# Altium schematic sheet CoinCraftA1.SchDoc (part 1 of 2) (continued)
## Parts (continued)
C6-3SO  value 470nF  [SMD_0603_CAPC1608X80N]  (hidden comment: (OPT) 470nF)
C6-4MO  (OPT)22uF/6.3V  [SMD_0805_CAPC2012X145N]
C6-4S  470nF  [SMD_0603_CAPC1608X80N]
C6-4SO  value 470nF  [SMD_0603_CAPC1608X80N]  (hidden comment: (OPT) 470nF)
C6-5  10uF/16V  [SMD_0805_CAPC2012X145N]
C6-5MO  (OPT)22uF/6.3V  [SMD_0805_CAPC2012X145N]
C6-5S  470nF  [SMD_0603_CAPC1608X80N]
C6-5SO  value 470nF  [SMD_0603_CAPC1608X80N]  (hidden comment: (OPT) 470nF)
C6-6  10uF/16V  [SMD_0805_CAPC2012X145N]
C6-6MO  (OPT)22uF/6.3V  [SMD_0805_CAPC2012X145N]
C6-6S  470nF  [SMD_0603_CAPC1608X80N]
C6-6SO  value 470nF  [SMD_0603_CAPC1608X80N]  (hidden comment: (OPT) 470nF)
C6-7MO  (OPT)22uF/6.3V  [SMD_0805_CAPC2012X145N]
C6-7S  470nF  [SMD_0603_CAPC1608X80N]
C6-7SO  value 470nF  [SMD_0603_CAPC1608X80N]  (hidden comment: (OPT) 470nF)
C6-8MO  (OPT)22uF/6.3V  [SMD_0805_CAPC2012X145N]
C6-8S  470nF  [SMD_0603_CAPC1608X80N]
C6-8SO  value 470nF  [SMD_0603_CAPC1608X80N]  (hidden comment: (OPT) 470nF)
C6_0  (OPT)22uF/6.3V  [SMD_0805_CAPC2012X145N]
C7-1MO  (OPT)22uF/6.3V  [SMD_0805_CAPC2012X145N]
C7-1S  470nF  [SMD_0603_CAPC1608X80N]
C7-1SO  value 470nF  [SMD_0603_CAPC1608X80N]  (hidden comment: (OPT) 470nF)
C7-2MO  (OPT)22uF/6.3V  [SMD_0805_CAPC2012X145N]
C7-2S  470nF  [SMD_0603_CAPC1608X80N]
C7-2SO  value 470nF  [SMD_0603_CAPC1608X80N]  (hidden comment: (OPT) 470nF)
C7-3MO  (OPT)22uF/6.3V  [SMD_0805_CAPC2012X145N]
C7-3S  470nF  [SMD_0603_CAPC1608X80N]
C7-3SO  value 470nF  [SMD_0603_CAPC1608X80N]  (hidden comment: (OPT) 470nF)
C7-4MO  (OPT)22uF/6.3V  [SMD_0805_CAPC2012X145N]
C7-4S  470nF  [SMD_0603_CAPC1608X80N]
C7-4SO  value 470nF  [SMD_0603_CAPC1608X80N]  (hidden comment: (OPT) 470nF)
C7-5  10uF/16V  [SMD_0805_CAPC2012X145N]
C7-5MO  (OPT)22uF/6.3V  [SMD_0805_CAPC2012X145N]
C7-5S  470nF  [SMD_0603_CAPC1608X80N]
C7-5SO  value 470nF  [SMD_0603_CAPC1608X80N]  (hidden comment: (OPT) 470nF)
C7-6  10uF/16V  [SMD_0805_CAPC2012X145N]
C7-6MO  (OPT)22uF/6.3V  [SMD_0805_CAPC2012X145N]
C7-6S  470nF  [SMD_0603_CAPC1608X80N]
C7-6SO  value 470nF  [SMD_0603_CAPC1608X80N]  (hidden comment: (OPT) 470nF)
C7-7MO  (OPT)22uF/6.3V  [SMD_0805_CAPC2012X145N]
C7-7S  470nF  [SMD_0603_CAPC1608X80N]
C7-7SO  value 470nF  [SMD_0603_CAPC1608X80N]  (hidden comment: (OPT) 470nF)
C7-8MO  (OPT)22uF/6.3V  [SMD_0805_CAPC2012X145N]
C7-8S  470nF  [SMD_0603_CAPC1608X80N]
C7-8SO  value 470nF  [SMD_0603_CAPC1608X80N]  (hidden comment: (OPT) 470nF)
C7_0  (OPT)22uF/6.3V  [SMD_0805_CAPC2012X145N]
C8-1MO  (OPT)22uF/6.3V  [SMD_0805_CAPC2012X145N]
C8-1S  470nF  [SMD_0603_CAPC1608X80N]
C8-1SO  value 470nF  [SMD_0603_CAPC1608X80N]  (hidden comment: (OPT) 470nF)
C8-2MO  (OPT)22uF/6.3V  [SMD_0805_CAPC2012X145N]
C8-2S  470nF  [SMD_0603_CAPC1608X80N]
C8-2SO  value 470nF  [SMD_0603_CAPC1608X80N]  (hidden comment: (OPT) 470nF)
C8-3MO  (OPT)22uF/6.3V  [SMD_0805_CAPC2012X145N]
C8-3S  470nF  [SMD_0603_CAPC1608X80N]
C8-3SO  value 470nF  [SMD_0603_CAPC1608X80N]  (hidden comment: (OPT) 470nF)
C8-4MO  (OPT)22uF/6.3V  [SMD_0805_CAPC2012X145N]
C8-4S  470nF  [SMD_0603_CAPC1608X80N]
C8-4SO  value 470nF  [SMD_0603_CAPC1608X80N]  (hidden comment: (OPT) 470nF)
C8-5  10uF/16V  [SMD_0805_CAPC2012X145N]
C8-5MO  (OPT)22uF/6.3V  [SMD_0805_CAPC2012X145N]
C8-5S  470nF  [SMD_0603_CAPC1608X80N]
C8-5SO  value 470nF  [SMD_0603_CAPC1608X80N]  (hidden comment: (OPT) 470nF)
C8-6  10uF/16V  [SMD_0805_CAPC2012X145N]
C8-6MO  (OPT)22uF/6.3V  [SMD_0805_CAPC2012X145N]
C8-6S  470nF  [SMD_0603_CAPC1608X80N]
C8-6SO  value 470nF  [SMD_0603_CAPC1608X80N]  (hidden comment: (OPT) 470nF)
C8-7MO  (OPT)22uF/6.3V  [SMD_0805_CAPC2012X145N]
C8-7S  470nF  [SMD_0603_CAPC1608X80N]
C8-7SO  value 470nF  [SMD_0603_CAPC1608X80N]  (hidden comment: (OPT) 470nF)
C8-8MO  (OPT)22uF/6.3V  [SMD_0805_CAPC2012X145N]
C8-8S  470nF  [SMD_0603_CAPC1608X80N]
C8-8SO  value 470nF  [SMD_0603_CAPC1608X80N]  (hidden comment: (OPT) 470nF)
C8_0  (OPT)22uF/6.3V  [SMD_0805_CAPC2012X145N]
C9-1MO  (OPT)22uF/6.3V  [SMD_0805_CAPC2012X145N]
C9-1S  470nF  [SMD_0603_CAPC1608X80N]
C9-1SO  value 470nF  [SMD_0603_CAPC1608X80N]  (hidden comment: (OPT) 470nF)
C9-2MO  (OPT)22uF/6.3V  [SMD_0805_CAPC2012X145N]
C9-2S  470nF  [SMD_0603_CAPC1608X80N]
C9-2SO  value 470nF  [SMD_0603_CAPC1608X80N]  (hidden comment: (OPT) 470nF)
C9-3MO  (OPT)22uF/6.3V  [SMD_0805_CAPC2012X145N]
C9-3S  470nF  [SMD_0603_CAPC1608X80N]
C9-3SO  value 470nF  [SMD_0603_CAPC1608X80N]  (hidden comment: (OPT) 470nF)
C9-4MO  (OPT)22uF/6.3V  [SMD_0805_CAPC2012X145N]
C9-4S  470nF  [SMD_0603_CAPC1608X80N]
C9-4SO  value 470nF  [SMD_0603_CAPC1608X80N]  (hidden comment: (OPT) 470nF)
C9-5  10uF/16V  [SMD_0805_CAPC2012X145N]
C9-5MO  (OPT)22uF/6.3V  [SMD_0805_CAPC2012X145N]
C9-5S  470nF  [SMD_0603_CAPC1608X80N]
C9-5SO  value 470nF  [SMD_0603_CAPC1608X80N]  (hidden comment: (OPT) 470nF)
C9-6  10uF/16V  [SMD_0805_CAPC2012X145N]
C9-6MO  (OPT)22uF/6.3V  [SMD_0805_CAPC2012X145N]
C9-6S  470nF  [SMD_0603_CAPC1608X80N]
C9-6SO  value 470nF  [SMD_0603_CAPC1608X80N]  (hidden comment: (OPT) 470nF)
C9-7MO  (OPT)22uF/6.3V  [SMD_0805_CAPC2012X145N]
C9-7S  470nF  [SMD_0603_CAPC1608X80N]
C9-7SO  value 470nF  [SMD_0603_CAPC1608X80N]  (hidden comment: (OPT) 470nF)
C9-8MO  (OPT)22uF/6.3V  [SMD_0805_CAPC2012X145N]
C9-8S  470nF  [SMD_0603_CAPC1608X80N]
C9-8SO  value 470nF  [SMD_0603_CAPC1608X80N]  (hidden comment: (OPT) 470nF)
C9_0  (OPT)22uF/6.3V  [SMD_0805_CAPC2012X145N]
C10-1MO  (OPT)22uF/6.3V  [SMD_0805_CAPC2012X145N]
C10-1S  470nF  [SMD_0603_CAPC1608X80N]
C10-1SO  value 470nF  [SMD_0603_CAPC1608X80N]  (hidden comment: (OPT) 470nF)
C10-2MO  (OPT)22uF/6.3V  [SMD_0805_CAPC2012X145N]
C10-2S  470nF  [SMD_0603_CAPC1608X80N]
C10-2SO  value 470nF  [SMD_0603_CAPC1608X80N]  (hidden comment: (OPT) 470nF)
C10-3MO  (OPT)22uF/6.3V  [SMD_0805_CAPC2012X145N]
C10-3S  470nF  [SMD_0603_CAPC1608X80N]
C10-3SO  value 470nF  [SMD_0603_CAPC1608X80N]  (hidden comment: (OPT) 470nF)
C10-4MO  (OPT)22uF/6.3V  [SMD_0805_CAPC2012X145N]
C10-4S  470nF  [SMD_0603_CAPC1608X80N]
C10-4SO  value 470nF  [SMD_0603_CAPC1608X80N]  (hidden comment: (OPT) 470nF)
C10-5  10uF/16V  [SMD_0805_CAPC2012X145N]
C10-5MO  (OPT)22uF/6.3V  [SMD_0805_CAPC2012X145N]
C10-5S  470nF  [SMD_0603_CAPC1608X80N]
C10-5SO  value 470nF  [SMD_0603_CAPC1608X80N]  (hidden comment: (OPT) 470nF)
C10-6  10uF/16V  [SMD_0805_CAPC2012X145N]
C10-6MO  (OPT)22uF/6.3V  [SMD_0805_CAPC2012X145N]
C10-6S  470nF  [SMD_0603_CAPC1608X80N]
C10-6SO  value 470nF  [SMD_0603_CAPC1608X80N]  (hidden comment: (OPT) 470nF)
C10-7MO  (OPT)22uF/6.3V  [SMD_0805_CAPC2012X145N]
C10-7S  470nF  [SMD_0603_CAPC1608X80N]
C10-7SO  value 470nF  [SMD_0603_CAPC1608X80N]  (hidden comment: (OPT) 470nF)
C10-8MO  (OPT)22uF/6.3V  [SMD_0805_CAPC2012X145N]
C10-8S  470nF  [SMD_0603_CAPC1608X80N]
C10-8SO  value 470nF  [SMD_0603_CAPC1608X80N]  (hidden comment: (OPT) 470nF)
C10_0  (OPT)22uF/6.3V  [SMD_0805_CAPC2012X145N]
C11-1MO  (OPT)22uF/6.3V  [SMD_0805_CAPC2012X145N]
C11-1SO  value 470nF  [SMD_0603_CAPC1608X80N]  (hidden comment: (OPT) 470nF)
C11-2MO  (OPT)22uF/6.3V  [SMD_0805_CAPC2012X145N]
C11-2S  470nF  [SMD_0603_CAPC1608X80N]
C11-2SO  value 470nF  [SMD_0603_CAPC1608X80N]  (hidden comment: (OPT) 470nF)
C11-3MO  (OPT)22uF/6.3V  [SMD_0805_CAPC2012X145N]
C11-3S  470nF  [SMD_0603_CAPC1608X80N]
C11-3SO  value 470nF  [SMD_0603_CAPC1608X80N]  (hidden comment: (OPT) 470nF)
C11-5  10uF/16V  [SMD_0805_CAPC2012X145N]
C11-5MO  (OPT)22uF/6.3V  [SMD_0805_CAPC2012X145N]
C11-5SO  value 470nF  [SMD_0603_CAPC1608X80N]  (hidden comment: (OPT) 470nF)
C11-6  10uF/16V  [SMD_0805_CAPC2012X145N]
C11-6S  470nF  [SMD_0603_CAPC1608X80N]
C11-7S  470nF  [SMD_0603_CAPC1608X80N]
C11-8MO  (OPT)22uF/6.3V  [SMD_0805_CAPC2012X145N]
C11-8SO  value 470nF  [SMD_0603_CAPC1608X80N]  (hidden comment: (OPT) 470nF)
C11_0  (OPT)22uF/6.3V  [SMD_0805_CAPC2012X145N]
C11_1  22uF/6.3V  [SMD_0805_CAPC2012X145N]
C11_2  22uF/6.3V  [SMD_0805_CAPC2012X145N]
C11_3  22uF/6.3V  [SMD_0805_CAPC2012X145N]
C11_4  22uF/6.3V  [SMD_0805_CAPC2012X145N]
C12-1MO  (OPT)22uF/6.3V  [SMD_0805_CAPC2012X145N]
C12-1SO  value 470nF  [SMD_0603_CAPC1608X80N]  (hidden comment: (OPT) 470nF)
C12-2MO  (OPT)22uF/6.3V  [SMD_0805_CAPC2012X145N]
C12-2S  470nF  [SMD_0603_CAPC1608X80N]
C12-2SO  value 470nF  [SMD_0603_CAPC1608X80N]  (hidden comment: (OPT) 470nF)
C12-3MO  (OPT)22uF/6.3V  [SMD_0805_CAPC2012X145N]
C12-3S  470nF  [SMD_0603_CAPC1608X80N]
C12-3SO  value 470nF  [SMD_0603_CAPC1608X80N]  (hidden comment: (OPT) 470nF)
C12-5  10uF/16V  [SMD_0805_CAPC2012X145N]
C12-5MO  (OPT)22uF/6.3V  [SMD_0805_CAPC2012X145N]
C12-5SO  value 470nF  [SMD_0603_CAPC1608X80N]  (hidden comment: (OPT) 470nF)
C12-6  10uF/16V  [SMD_0805_CAPC2012X145N]
C12-6S  470nF  [SMD_0603_CAPC1608X80N]
C12-7S  470nF  [SMD_0603_CAPC1608X80N]
C12-8MO  (OPT)22uF/6.3V  [SMD_0805_CAPC2012X145N]
C12-8SO  value 470nF  [SMD_0603_CAPC1608X80N]  (hidden comment: (OPT) 470nF)
C12_0  (OPT)22uF/6.3V  [SMD_0805_CAPC2012X145N]
C12_1  22uF/6.3V  [SMD_0805_CAPC2012X145N]
C12_2  22uF/6.3V  [SMD_0805_CAPC2012X145N]
C12_3  22uF/6.3V  [SMD_0805_CAPC2012X145N]
C12_4  22uF/6.3V  [SMD_0805_CAPC2012X145N]
C13-2S  470nF  [SMD_0603_CAPC1608X80N]
C13-3S  470nF  [SMD_0603_CAPC1608X80N]
C13-5  10uF/16V  [SMD_0805_CAPC2012X145N]
C13-5MO  (OPT)22uF/6.3V  [SMD_0805_CAPC2012X145N]
C13-5SO  value 470nF  [SMD_0603_CAPC1608X80N]  (hidden comment: (OPT) 470nF)
C13-6  10uF/16V  [SMD_0805_CAPC2012X145N]
C13-6S  470nF  [SMD_0603_CAPC1608X80N]
C13-7S  470nF  [SMD_0603_CAPC1608X80N]
C13-8MO  (OPT)22uF/6.3V  [SMD_0805_CAPC2012X145N]
C13-8SO  value 470nF  [SMD_0603_CAPC1608X80N]  (hidden comment: (OPT) 470nF)
C13_0  (OPT)22uF/6.3V  [SMD_0805_CAPC2012X145N]
C13_1  22uF/6.3V  [SMD_0805_CAPC2012X145N]
C13_2  22uF/6.3V  [SMD_0805_CAPC2012X145N]
C13_3  22uF/6.3V  [SMD_0805_CAPC2012X145N]
C13_4  22uF/6.3V  [SMD_0805_CAPC2012X145N]
C14-5  10uF/16V  [SMD_0805_CAPC2012X145N]
C14-5MO  (OPT)22uF/6.3V  [SMD_0805_CAPC2012X145N]
C14-5SO  value 470nF  [SMD_0603_CAPC1608X80N]  (hidden comment: (OPT) 470nF)
C14-6  10uF/16V  [SMD_0805_CAPC2012X145N]
C14-8MO  (OPT)22uF/6.3V  [SMD_0805_CAPC2012X145N]
C14-8SO  value 470nF  [SMD_0603_CAPC1608X80N]  (hidden comment: (OPT) 470nF)
C14_0  (OPT)22uF/6.3V  [SMD_0805_CAPC2012X145N]
C14_1  22uF/6.3V  [SMD_0805_CAPC2012X145N]
C14_2  22uF/6.3V  [SMD_0805_CAPC2012X145N]
C14_3  22uF/6.3V  [SMD_0805_CAPC2012X145N]
C14_4  22uF/6.3V  [SMD_0805_CAPC2012X145N]
C15-5  10uF/16V  [SMD_0805_CAPC2012X145N]
C15-6  10uF/16V  [SMD_0805_CAPC2012X145N]
C15-8MO  (OPT)22uF/6.3V  [SMD_0805_CAPC2012X145N]
C15-8SO  value 470nF  [SMD_0603_CAPC1608X80N]  (hidden comment: (OPT) 470nF)
C15_0  (OPT)22uF/6.3V  [SMD_0805_CAPC2012X145N]
C15_1  22uF/6.3V  [SMD_0805_CAPC2012X145N]
C15_2  22uF/6.3V  [SMD_0805_CAPC2012X145N]
C15_3  22uF/6.3V  [SMD_0805_CAPC2012X145N]
C15_4  22uF/6.3V  [SMD_0805_CAPC2012X145N]
C16-5  10uF/16V  [SMD_0805_CAPC2012X145N]
C16-6  10uF/16V  [SMD_0805_CAPC2012X145N]
C16-8MO  (OPT)22uF/6.3V  [SMD_0805_CAPC2012X145N]
C16-8SO  value 470nF  [SMD_0603_CAPC1608X80N]  (hidden comment: (OPT) 470nF)
C16_0  (OPT)22uF/6.3V  [SMD_0805_CAPC2012X145N]
C16_1  22uF/6.3V  [SMD_0805_CAPC2012X145N]
C16_2  22uF/6.3V  [SMD_0805_CAPC2012X145N]
C16_3  22uF/6.3V  [SMD_0805_CAPC2012X145N]
C16_4  22uF/6.3V  [SMD_0805_CAPC2012X145N]
C17  10uF/16V  [SMD_0805_CAPC2012X145N]
C17_0  (OPT)22uF/6.3V  [SMD_0805_CAPC2012X145N]
C17_1  22uF/6.3V  [SMD_0805_CAPC2012X145N]
C17_2  22uF/6.3V  [SMD_0805_CAPC2012X145N]
C17_3  22uF/6.3V  [SMD_0805_CAPC2012X145N]
C17_4  22uF/6.3V  [SMD_0805_CAPC2012X145N]
C18_0  (OPT)22uF/6.3V  [SMD_0805_CAPC2012X145N]
C18_1  22uF/6.3V  [SMD_0805_CAPC2012X145N]
C18_2  22uF/6.3V  [SMD_0805_CAPC2012X145N]
C18_3  22uF/6.3V  [SMD_0805_CAPC2012X145N]
C18_4  22uF/6.3V  [SMD_0805_CAPC2012X145N]
C19_1  22uF/6.3V  [SMD_0805_CAPC2012X145N]
C19_2  22uF/6.3V  [SMD_0805_CAPC2012X145N]
C19_3  22uF/6.3V  [SMD_0805_CAPC2012X145N]
C19_4  22uF/6.3V  [SMD_0805_CAPC2012X145N]
C20-5  (OPT)100uF  [SMD_1210_CAPC3225X279N]
C20-6  (OPT)100uF  [SMD_1210_CAPC3225X279N]
C20_0  220uF  [SMD_1210_CAPC3225X279N]
C20_1  22uF/6.3V  [SMD_0805_CAPC2012X145N]
C20_2  22uF/6.3V  [SMD_0805_CAPC2012X145N]
C20_3  22uF/6.3V  [SMD_0805_CAPC2012X145N]
C20_4  22uF/6.3V  [SMD_0805_CAPC2012X145N]
C21-5  (OPT)100uF  [SMD_1210_CAPC3225X279N]
C21-6  (OPT)100uF  [SMD_1210_CAPC3225X279N]
C21_0  220uF  [SMD_1210_CAPC3225X279N]
C21_1  22uF/6.3V  [SMD_0805_CAPC2012X145N]
C21_2  22uF/6.3V  [SMD_0805_CAPC2012X145N]
C21_3  22uF/6.3V  [SMD_0805_CAPC2012X145N]
C21_4  22uF/6.3V  [SMD_0805_CAPC2012X145N]
C22-5  (OPT)100uF  [SMD_1210_CAPC3225X279N]
C22-6  (OPT)100uF  [SMD_1210_CAPC3225X279N]
C22_0  220uF  [SMD_1210_CAPC3225X279N]
C22_1  22uF/6.3V  [SMD_0805_CAPC2012X145N]
C22_2  22uF/6.3V  [SMD_0805_CAPC2012X145N]
C22_3  22uF/6.3V  [SMD_0805_CAPC2012X145N]
C22_4  22uF/6.3V  [SMD_0805_CAPC2012X145N]
C23-5  (OPT)100uF  [SMD_1210_CAPC3225X279N]
C23-6  (OPT)100uF  [SMD_1210_CAPC3225X279N]
C23_0  220uF  [SMD_1210_CAPC3225X279N]
C23_1  22uF/6.3V  [SMD_0805_CAPC2012X145N]
C23_2  22uF/6.3V  [SMD_0805_CAPC2012X145N]
C23_3  22uF/6.3V  [SMD_0805_CAPC2012X145N]
C23_4  22uF/6.3V  [SMD_0805_CAPC2012X145N]
C24-5  (OPT)100uF  [SMD_1210_CAPC3225X279N]
C24-6  (OPT)100uF  [SMD_1210_CAPC3225X279N]
C24_0  220uF  [SMD_1210_CAPC3225X279N]
C24_1  22uF/6.3V  [SMD_0805_CAPC2012X145N]
C24_3  22uF/6.3V  [SMD_0805_CAPC2012X145N]
C24_4  22uF/6.3V  [SMD_0805_CAPC2012X145N]
C25-5  (OPT)100uF  [SMD_1210_CAPC3225X279N]
C25-6  (OPT)100uF  [SMD_1210_CAPC3225X279N]
C25_0  220uF  [SMD_1210_CAPC3225X279N]
C25_1  22uF/6.3V  [SMD_0805_CAPC2012X145N]
C25_3  22uF/6.3V  [SMD_0805_CAPC2012X145N]
C25_4  22uF/6.3V  [SMD_0805_CAPC2012X145N]
C26-5  (OPT)100uF  [SMD_1210_CAPC3225X279N]
C26-6  (OPT)100uF  [SMD_1210_CAPC3225X279N]
C26_0  220uF  [SMD_1210_CAPC3225X279N]
C26_1  22uF/6.3V  [SMD_0805_CAPC2012X145N]
C26_2  22uF/6.3V  [SMD_0805_CAPC2012X145N]
C26_3  22uF/6.3V  [SMD_0805_CAPC2012X145N]
C26_4  22uF/6.3V  [SMD_0805_CAPC2012X145N]
C27-5  (OPT)100uF  [SMD_1210_CAPC3225X279N]
C27-6  (OPT)100uF  [SMD_1210_CAPC3225X279N]
C27_0  220uF  [SMD_1210_CAPC3225X279N]
C28_0  220uF  [SMD_1210_CAPC3225X279N]
C31_1  10uF/16V  [SMD_0805_CAPC2012X145N]
C31_2  10uF/16V  [SMD_0805_CAPC2012X145N]
C31_3  10uF/16V  [SMD_0805_CAPC2012X145N]
C31_4  10uF/16V  [SMD_0805_CAPC2012X145N]
C32_1  10uF/16V  [SMD_0805_CAPC2012X145N]
C32_2  10uF/16V  [SMD_0805_CAPC2012X145N]
C32_3  10uF/16V  [SMD_0805_CAPC2012X145N]
C32_4  10uF/16V  [SMD_0805_CAPC2012X145N]
C33_1  10uF/16V  [SMD_0805_CAPC2012X145N]
C33_2  10uF/16V  [SMD_0805_CAPC2012X145N]
C33_3  10uF/16V  [SMD_0805_CAPC2012X145N]
C33_4  10uF/16V  [SMD_0805_CAPC2012X145N]
C34  100nF  [SMD_0603_CAPC1608X80N]
C34_1  10uF/16V  [SMD_0805_CAPC2012X145N]
C34_2  10uF/16V  [SMD_0805_CAPC2012X145N]
C34_3  10uF/16V  [SMD_0805_CAPC2012X145N]
C34_4  10uF/16V  [SMD_0805_CAPC2012X145N]
C35_1  10uF/16V  [SMD_0805_CAPC2012X145N]
C35_2  10uF/16V  [SMD_0805_CAPC2012X145N]
C35_3  10uF/16V  [SMD_0805_CAPC2012X145N]
C35_4  10uF/16V  [SMD_0805_CAPC2012X145N]
C36_1  10uF/16V  [SMD_0805_CAPC2012X145N]
C36_2  10uF/16V  [SMD_0805_CAPC2012X145N]
C36_3  10uF/16V  [SMD_0805_CAPC2012X145N]
C36_4  10uF/16V  [SMD_0805_CAPC2012X145N]
C37_1  10uF/16V  [SMD_0805_CAPC2012X145N]
C37_2  10uF/16V  [SMD_0805_CAPC2012X145N]
C37_3  10uF/16V  [SMD_0805_CAPC2012X145N]
C37_4  10uF/16V  [SMD_0805_CAPC2012X145N]
C38_1  10uF/16V  [SMD_0805_CAPC2012X145N]
C38_2  10uF/16V  [SMD_0805_CAPC2012X145N]
C38_3  10uF/16V  [SMD_0805_CAPC2012X145N]
C38_4  10uF/16V  [SMD_0805_CAPC2012X145N]
C39_1  10uF/16V  [SMD_0805_CAPC2012X145N]
C39_2  10uF/16V  [SMD_0805_CAPC2012X145N]
C39_3  10uF/16V  [SMD_0805_CAPC2012X145N]
C39_4  10uF/16V  [SMD_0805_CAPC2012X145N]
C40_1  10uF/16V  [SMD_0805_CAPC2012X145N]
C40_2  10uF/16V  [SMD_0805_CAPC2012X145N]
C40_3  10uF/16V  [SMD_0805_CAPC2012X145N]
C40_4  10uF/16V  [SMD_0805_CAPC2012X145N]
C40_5  22uF/6.3V  [SMD_0805_CAPC2012X145N]
C40_6  22uF/6.3V  [SMD_0805_CAPC2012X145N]
C41_1  10uF/16V  [SMD_0805_CAPC2012X145N]
C41_2  10uF/16V  [SMD_0805_CAPC2012X145N]
C41_3  10uF/16V  [SMD_0805_CAPC2012X145N]
C41_4  10uF/16V  [SMD_0805_CAPC2012X145N]
C41_5  22uF/6.3V  [SMD_0805_CAPC2012X145N]
C41_6  22uF/6.3V  [SMD_0805_CAPC2012X145N]
C42_1  10uF/16V  [SMD_0805_CAPC2012X145N]
C42_2  10uF/16V  [SMD_0805_CAPC2012X145N]
C42_3  10uF/16V  [SMD_0805_CAPC2012X145N]
C42_4  10uF/16V  [SMD_0805_CAPC2012X145N]
C42_5  22uF/6.3V  [SMD_0805_CAPC2012X145N]
C42_6  22uF/6.3V  [SMD_0805_CAPC2012X145N]
C43  1nF  [SMD_0603_CAPC1608X80N]
C43_1  10uF/16V  [SMD_0805_CAPC2012X145N]
C43_2  10uF/16V  [SMD_0805_CAPC2012X145N]
C43_3  10uF/16V  [SMD_0805_CAPC2012X145N]
C43_4  10uF/16V  [SMD_0805_CAPC2012X145N]
C43_5  22uF/6.3V  [SMD_0805_CAPC2012X145N]
C43_6  22uF/6.3V  [SMD_0805_CAPC2012X145N]
C44  1nF  [SMD_0603_CAPC1608X80N]
C44_1  10uF/16V  [SMD_0805_CAPC2012X145N]
C44_2  10uF/16V  [SMD_0805_CAPC2012X145N]
C44_3  10uF/16V  [SMD_0805_CAPC2012X145N]
C44_4  10uF/16V  [SMD_0805_CAPC2012X145N]
C44_5  22uF/6.3V  [SMD_0805_CAPC2012X145N]
C44_6  22uF/6.3V  [SMD_0805_CAPC2012X145N]
C45_1  10uF/16V  [SMD_0805_CAPC2012X145N]
C45_2  10uF/16V  [SMD_0805_CAPC2012X145N]
C45_3  10uF/16V  [SMD_0805_CAPC2012X145N]
C45_4  10uF/16V  [SMD_0805_CAPC2012X145N]
C45_5  22uF/6.3V  [SMD_0805_CAPC2012X145N]
C45_6  22uF/6.3V  [SMD_0805_CAPC2012X145N]
C46_1  10uF/16V  [SMD_0805_CAPC2012X145N]
C46_2  10uF/16V  [SMD_0805_CAPC2012X145N]
C46_3  10uF/16V  [SMD_0805_CAPC2012X145N]
C46_4  10uF/16V  [SMD_0805_CAPC2012X145N]
C46_5  22uF/6.3V  [SMD_0805_CAPC2012X145N]
C46_6  22uF/6.3V  [SMD_0805_CAPC2012X145N]
C47_5  22uF/6.3V  [SMD_0805_CAPC2012X145N]
C47_6  22uF/6.3V  [SMD_0805_CAPC2012X145N]
C48_5  22uF/6.3V  [SMD_0805_CAPC2012X145N]
C48_6  22uF/6.3V  [SMD_0805_CAPC2012X145N]
C49_5  22uF/6.3V  [SMD_0805_CAPC2012X145N]
C49_6  22uF/6.3V  [SMD_0805_CAPC2012X145N]
C50_5  22uF/6.3V  [SMD_0805_CAPC2012X145N]
C50_6  22uF/6.3V  [SMD_0805_CAPC2012X145N]
C51_1  (OPT)100uF  [SMD_1210_CAPC3225X279N]
C51_2  (OPT)100uF  [SMD_1210_CAPC3225X279N]
C51_3  (OPT)100uF  [SMD_1210_CAPC3225X279N]
C51_4  (OPT)100uF  [SMD_1210_CAPC3225X279N]
C51_5  22uF/6.3V  [SMD_0805_CAPC2012X145N]
C51_6  22uF/6.3V  [SMD_0805_CAPC2012X145N]
C52_1  (OPT)100uF  [SMD_1210_CAPC3225X279N]
C52_2  (OPT)100uF  [SMD_1210_CAPC3225X279N]
C52_3  (OPT)100uF  [SMD_1210_CAPC3225X279N]
C52_4  (OPT)100uF  [SMD_1210_CAPC3225X279N]
C52_5  22uF/6.3V  [SMD_0805_CAPC2012X145N]
C52_6  22uF/6.3V  [SMD_0805_CAPC2012X145N]
C53_1  (OPT)100uF  [SMD_1210_CAPC3225X279N]
C53_2  (OPT)100uF  [SMD_1210_CAPC3225X279N]
C53_3  (OPT)100uF  [SMD_1210_CAPC3225X279N]
C53_4  (OPT)100uF  [SMD_1210_CAPC3225X279N]
C53_5  22uF/6.3V  [SMD_0805_CAPC2012X145N]
C53_6  22uF/6.3V  [SMD_0805_CAPC2012X145N]
C54_1  (OPT)100uF  [SMD_1210_CAPC3225X279N]
C54_2  (OPT)100uF  [SMD_1210_CAPC3225X279N]
C54_3  (OPT)100uF  [SMD_1210_CAPC3225X279N]
C54_4  (OPT)100uF  [SMD_1210_CAPC3225X279N]
C54_5  22uF/6.3V  [SMD_0805_CAPC2012X145N]
C54_6  22uF/6.3V  [SMD_0805_CAPC2012X145N]
C55_1  (OPT)100uF  [SMD_1210_CAPC3225X279N]
C55_2  (OPT)100uF  [SMD_1210_CAPC3225X279N]
C55_3  (OPT)100uF  [SMD_1210_CAPC3225X279N]
C55_4  (OPT)100uF  [SMD_1210_CAPC3225X279N]
C55_5  22uF/6.3V  [SMD_0805_CAPC2012X145N]
C55_6  22uF/6.3V  [SMD_0805_CAPC2012X145N]
C56_1  (OPT)100uF  [SMD_1210_CAPC3225X279N]
C56_2  (OPT)100uF  [SMD_1210_CAPC3225X279N]
C56_3  (OPT)100uF  [SMD_1210_CAPC3225X279N]
C56_4  (OPT)100uF  [SMD_1210_CAPC3225X279N]
C57_1  (OPT)100uF  [SMD_1210_CAPC3225X279N]
C57_2  (OPT)100uF  [SMD_1210_CAPC3225X279N]
C57_3  (OPT)100uF  [SMD_1210_CAPC3225X279N]
C57_4  (OPT)100uF  [SMD_1210_CAPC3225X279N]
C58_1  (OPT)100uF  [SMD_1210_CAPC3225X279N]
C58_2  (OPT)100uF  [SMD_1210_CAPC3225X279N]
C58_3  (OPT)100uF  [SMD_1210_CAPC3225X279N]
C58_4  (OPT)100uF  [SMD_1210_CAPC3225X279N]
C61_1  (OPT)220uF  [SMD_1210_CAPC3225X279N]
C61_2  (OPT)220uF  [SMD_1210_CAPC3225X279N]
C61_3  (OPT)220uF  [SMD_1210_CAPC3225X279N]
C61_4  (OPT)220uF  [SMD_1210_CAPC3225X279N]
C61_5  (OPT)220uF  [SMD_1210_CAPC3225X279N]
C61_6  (OPT)220uF  [SMD_1210_CAPC3225X279N]
C62_1  (OPT)220uF  [SMD_1210_CAPC3225X279N]
C62_2  (OPT)220uF  [SMD_1210_CAPC3225X279N]
C62_3  (OPT)220uF  [SMD_1210_CAPC3225X279N]
C62_4  (OPT)220uF  [SMD_1210_CAPC3225X279N]
C62_5  (OPT)220uF  [SMD_1210_CAPC3225X279N]
C62_6  (OPT)220uF  [SMD_1210_CAPC3225X279N]
C63  22uF/6.3V  [SMD_0805_CAPC2012X145N]
C63_1  (OPT)220uF  [SMD_1210_CAPC3225X279N]
C63_2  (OPT)220uF  [SMD_1210_CAPC3225X279N]
C63_3  (OPT)220uF  [SMD_1210_CAPC3225X279N]
C63_4  (OPT)220uF  [SMD_1210_CAPC3225X279N]
C63_5  (OPT)220uF  [SMD_1210_CAPC3225X279N]
C63_6  (OPT)220uF  [SMD_1210_CAPC3225X279N]
C64_1  (OPT)220uF  [SMD_1210_CAPC3225X279N]
C64_2  (OPT)220uF  [SMD_1210_CAPC3225X279N]
C64_3  (OPT)220uF  [SMD_1210_CAPC3225X279N]
C64_4  (OPT)220uF  [SMD_1210_CAPC3225X279N]
C64_5  (OPT)220uF  [SMD_1210_CAPC3225X279N]
C64_6  (OPT)220uF  [SMD_1210_CAPC3225X279N]
C65_1  (OPT)220uF  [SMD_1210_CAPC3225X279N]
C65_2  (OPT)220uF  [SMD_1210_CAPC3225X279N]
C65_3  (OPT)220uF  [SMD_1210_CAPC3225X279N]
C65_4  (OPT)220uF  [SMD_1210_CAPC3225X279N]
C65_5  (OPT)220uF  [SMD_1210_CAPC3225X279N]
C65_6  (OPT)220uF  [SMD_1210_CAPC3225X279N]
C66_1  (OPT)220uF  [SMD_1210_CAPC3225X279N]
C66_2  (OPT)220uF  [SMD_1210_CAPC3225X279N]
C66_3  (OPT)220uF  [SMD_1210_CAPC3225X279N]
C66_4  (OPT)220uF  [SMD_1210_CAPC3225X279N]
C66_5  (OPT)220uF  [SMD_1210_CAPC3225X279N]
C66_6  (OPT)220uF  [SMD_1210_CAPC3225X279N]
C67_1  (OPT)220uF  [SMD_1210_CAPC3225X279N]
C67_2  (OPT)220uF  [SMD_1210_CAPC3225X279N]
C67_3  (OPT)220uF  [SMD_1210_CAPC3225X279N]
C67_4  (OPT)220uF  [SMD_1210_CAPC3225X279N]
C67_5  (OPT)220uF  [SMD_1210_CAPC3225X279N]
C67_6  (OPT)220uF  [SMD_1210_CAPC3225X279N]
C68_1  (OPT)220uF  [SMD_1210_CAPC3225X279N]
C68_2  (OPT)220uF  [SMD_1210_CAPC3225X279N]
C68_3  (OPT)220uF  [SMD_1210_CAPC3225X279N]
C68_4  (OPT)220uF  [SMD_1210_CAPC3225X279N]
C68_5  (OPT)220uF  [SMD_1210_CAPC3225X279N]
C68_6  (OPT)220uF  [SMD_1210_CAPC3225X279N]
C72  100nF  [SMD_0603_CAPC1608X80N]
C73  100nF  [SMD_0603_CAPC1608X80N]
C74  100nF  [SMD_0603_CAPC1608X80N]
C75  100nF  [SMD_0603_CAPC1608X80N]
C76  100nF  [SMD_0603_CAPC1608X80N]
C81_2  22uF/6.3V  [SMD_0805_CAPC2012X145N]
C82_2  22uF/6.3V  [SMD_0805_CAPC2012X145N]
C85  18pF  [SMD_0603_CAPC1608X80N]
C86  18pF  [SMD_0603_CAPC1608X80N]
C187  10uF/16V  [SMD_0805_CAPC2012X145N]
C206  22uF/6.3V  [SMD_0805_CAPC2012X145N]
C211  22uF/6.3V  [SMD_0805_CAPC2012X145N]
C229  22uF/6.3V  [SMD_0805_CAPC2012X145N]
C231  10uF/16V  [SMD_0805_CAPC2012X145N]
C233  22uF/6.3V  [SMD_0805_CAPC2012X145N]
C234  22uF/6.3V  [SMD_0805_CAPC2012X145N]
C237  22uF/6.3V  [SMD_0805_CAPC2012X145N]
C248  22uF/6.3V  [SMD_0805_CAPC2012X145N]
C249  22uF/6.3V  [SMD_0805_CAPC2012X145N]
C250  22uF/6.3V  [SMD_0805_CAPC2012X145N]
C251  1nF  [SMD_0603_CAPC1608X80N]
C325  1nF  [SMD_0603_CAPC1608X80N]
C358  220uF  [SMD_1210_CAPC3225X279N]
C359  220uF  [SMD_1210_CAPC3225X279N]
C360  220uF  [SMD_1210_CAPC3225X279N]
C364  220uF  [SMD_1210_CAPC3225X279N]
C366  220uF  [SMD_1210_CAPC3225X279N]
C367  220uF  [SMD_1210_CAPC3225X279N]
C371  220uF  [SMD_1210_CAPC3225X279N]
C374  220uF  [SMD_1210_CAPC3225X279N]
C375  220uF  [SMD_1210_CAPC3225X279N]
C376  220uF  [SMD_1210_CAPC3225X279N]
C377  220uF  [SMD_1210_CAPC3225X279N]
C378  220uF  [SMD_1210_CAPC3225X279N]
C379  220uF  [SMD_1210_CAPC3225X279N]
C383  220uF  [SMD_1210_CAPC3225X279N]
C387  220uF  [SMD_1210_CAPC3225X279N]
C503  220uF  [SMD_1210_CAPC3225X279N]
C504  220uF  [SMD_1210_CAPC3225X279N]
C505  220uF  [SMD_1210_CAPC3225X279N]
C506  220uF  [SMD_1210_CAPC3225X279N]
C507  220uF  [SMD_1210_CAPC3225X279N]
C508  220uF  [SMD_1210_CAPC3225X279N]
C509  220uF  [SMD_1210_CAPC3225X279N]
C510  220uF  [SMD_1210_CAPC3225X279N]
C511  220uF  [SMD_1210_CAPC3225X279N]
C512  220uF  [SMD_1210_CAPC3225X279N]
C513  220uF  [SMD_1210_CAPC3225X279N]
C514  220uF  [SMD_1210_CAPC3225X279N]
C515  220uF  [SMD_1210_CAPC3225X279N]
C516  220uF  [SMD_1210_CAPC3225X279N]
C517  220uF  [SMD_1210_CAPC3225X279N]
C518  220uF  [SMD_1210_CAPC3225X279N]
C519  220uF  [SMD_1210_CAPC3225X279N]
C520  220uF  [SMD_1210_CAPC3225X279N]
C521  220uF  [SMD_1210_CAPC3225X279N]
C522  220uF  [SMD_1210_CAPC3225X279N]
C523  220uF  [SMD_1210_CAPC3225X279N]
C524  220uF  [SMD_1210_CAPC3225X279N]
C525  220uF  [SMD_1210_CAPC3225X279N]
C526  220uF  [SMD_1210_CAPC3225X279N]
C528  220uF  [SMD_1210_CAPC3225X279N]
C529  220uF  [SMD_1210_CAPC3225X279N]
C530  220uF  [SMD_1210_CAPC3225X279N]
C531  220uF  [SMD_1210_CAPC3225X279N]
C532  220uF  [SMD_1210_CAPC3225X279N]
C533  220uF  [SMD_1210_CAPC3225X279N]
C534  220uF  [SMD_1210_CAPC3225X279N]
C536  220uF  [SMD_1210_CAPC3225X279N]
D1_1  BAT54C  [SMD_SOT23_SOT95P240X120-3N]
D1_2  BAT54C  [SMD_SOT23_SOT95P240X120-3N]
D1_3  BAT54C  [SMD_SOT23_SOT95P240X120-3N]
D1_4  BAT54C  [SMD_SOT23_SOT95P240X120-3N]
D1_5  BAT54C  [SMD_SOT23_SOT95P240X120-3N]
D1_6  BAT54C  [SMD_SOT23_SOT95P240X120-3N]
D3  (OPT) BAV56  [SMD_SOT23_SOT95P240X120-3N]
D4  Red SML210VT ROHM  [SMD_0805_LED2012X100N]
D5  Green 	SML210MT ROHM  [SMD_0805_LED2012X100N]
D6  Yellow SML210YT ROHM  [SMD_0805_LED2012X100N]
D7  Orange 	SML210DT ROHM  [SMD_0805_LED2012X100N]
D8  (OPT) SMBJ12A  [SMD_DO214AC_SMB]
D9  (OPT) SMBJ12A  [SMD_DO214AC_SMB]
D11  (OPT)SS14  [SMD_DO214AC_SMA]
D12  (OPT)SS14  [SMD_DO214AC_SMA]
D13  SS14  [SMD_DO214AC_SMA]
D14  SMCJ12A  [SMD_DO214AC_SMC]
D16  SMS05T1G  [SMD_SOT95P280X145-6N-W]
F1  MF-USMF050  [PTH_CAPRR500W60L400T500H750A]
F2  MF-USMF050  [PTH_CAPRR500W60L400T500H750A]
F3  MF-USMF050  [PTH_CAPRR500W60L400T500H750A]
F4  MF-USMF050  [PTH_CAPRR500W60L400T500H750A]
F5  MF-USMF050  [PTH_CAPRR500W60L400T500H750A]
F6  MF-USMF050  [PTH_CAPRR500W60L400T500H750A]
F7  MF-USMF050  [PTH_CAPRR500W60L400T500H750A]
F8  MF-USMF050  [PTH_CAPRR500W60L400T500H750A]
F9  MF-USMF050  [PTH_CAPRR500W60L400T500H750A]
F10  MF-USMF050  [PTH_CAPRR500W60L400T500H750A]
F11  MF-USMF050  [PTH_CAPRR500W60L400T500H750A]
F12  MF-USMF050  [PTH_CAPRR500W60L400T500H750A]
J1  (OPT) CON PROGRAM  [SIP5 PGM TOP]
J2  CON_3PINS  [PTH_CON_3.5mm_3PINs]
J3  CU04SCM15B0-R0  [SMD_CON-CVILUX-CU04-SCM15B0]
J4  WURTH 649 006 295 22  [PTH_CON_PCI-E]
J5  WURTH 649 006 295 22  [PTH_CON_PCI-E]
L1_1  SLC1480-201MLD  [SMD_INDM12501250X800A - Coilcraft SLC1480]
L1_2  SLC1480-201MLD  [SMD_INDM12501250X800A - Coilcraft SLC1480]
L1_3  SLC1480-201MLD  [SMD_INDM12501250X800A - Coilcraft SLC1480]
L1_4  SLC1480-201MLD  [SMD_INDM12501250X800A - Coilcraft SLC1480]
L1_5  SLC1480-201MLD  [SMD_INDM12501250X800A - Coilcraft SLC1480]
L1_6  SLC1480-201MLD  [SMD_INDM12501250X800A - Coilcraft SLC1480]
Q1_1  AP1RA03GMT-3  [SMD_SON127P615X520X100-8N]
Q1_2  AP1RA03GMT-3  [SMD_SON127P615X520X100-8N]
Q1_3  AP1RA03GMT-3  [SMD_SON127P615X520X100-8N]
Q1_4  AP1RA03GMT-3  [SMD_SON127P615X520X100-8N]
Q1_5  AP1RA03GMT-3  [SMD_SON127P615X520X100-8N]
Q1_6  AP1RA03GMT-3  [SMD_SON127P615X520X100-8N]
Q2_1  AP1RA03GMT-3  [SMD_SON127P615X520X100-8N]
Q2_2  AP1RA03GMT-3  [SMD_SON127P615X520X100-8N]
Q2_3  AP1RA03GMT-3  [SMD_SON127P615X520X100-8N]
Q2_4  AP1RA03GMT-3  [SMD_SON127P615X520X100-8N]
Q2_5  AP1RA03GMT-3  [SMD_SON127P615X520X100-8N]
Q2_6  AP1RA03GMT-3  [SMD_SON127P615X520X100-8N]
Q3_1  AP1RA03GMT-3  [SMD_SON127P615X520X100-8N]
Q3_2  AP1RA03GMT-3  [SMD_SON127P615X520X100-8N]
Q3_3  AP1RA03GMT-3  [SMD_SON127P615X520X100-8N]
Q3_4  AP1RA03GMT-3  [SMD_SON127P615X520X100-8N]
Q3_5  AP1RA03GMT-3  [SMD_SON127P615X520X100-8N]
Q3_6  AP1RA03GMT-3  [SMD_SON127P615X520X100-8N]
Q7  BSS138  [SMD_SOT23_SOT95P240X120-3N]
R1  1k  [SMD_0603_RESC1608X55N]
R2  0  [SMD_0603_RESC1608X55N]
R3  1k  [SMD_0603_RESC1608X55N]
R4  1k  [SMD_0603_RESC1608X55N]
R5  1k  [SMD_0603_RESC1608X55N]
R6  1k  [SMD_0603_RESC1608X55N]
R7  10k  [SMD_0603_RESC1608X55N]
R8  10k  [SMD_0603_RESC1608X55N]
R9  10k  [SMD_0603_RESC1608X55N]
R10  10k  [SMD_0603_RESC1608X55N]
R11  10k  [SMD_0603_RESC1608X55N]
R12  0  [SMD_0603_RESC1608X55N]
R13  (OPT)0  [SMD_0603_RESC1608X55N]
R14  10k  [SMD_0603_RESC1608X55N]
R15  10k  [SMD_0603_RESC1608X55N]
R16  10k  [SMD_0603_RESC1608X55N]
R17  (OPT)10k  [SMD_0603_RESC1608X55N]
R18  10k  [SMD_0603_RESC1608X55N]
R19  1k  [SMD_0603_RESC1608X55N]
R20  1k  [SMD_0603_RESC1608X55N]
R21  100  [SMD_1206_RESC3216X180N]
R22  1k  [SMD_0603_RESC1608X55N]
R23  (OPT)0  [SMD_0603_RESC1608X55N]
R31  0  [SMD_0603_RESC1608X55N]
R32  (OPT)1k  [SMD_0603_RESC1608X55N]
R33  0  [SMD_0603_RESC1608X55N]
R34  47  [SMD_0603_RESC1608X55N]
R35  47  [SMD_0603_RESC1608X55N]
R40  10k  [SMD_0603_RESC1608X55N]
R43  10k  [SMD_0603_RESC1608X55N]
R47  2  [SMD_1206_RESC3216X180N]
R57  10k  [SMD_0603_RESC1608X55N]
R59  10k  [SMD_0603_RESC1608X55N]
R60  0  [SMD_1206_RESC3216X180N]
R61  2.4k  [SMD_0603_RESC1608X55N]
U1  dsPIC33EP256MU806  [SMD_QFP50P1200X1200X120-64N]
U1_1  LTC 4449  [SMD_SOP65P490X110-9N - DUAL]
U1_2  LTC 4449  [SMD_SOP65P490X110-9N - DUAL]
U1_3  LTC 4449  [SMD_SOP65P490X110-9N - DUAL]
U1_4  LTC 4449  [SMD_SOP65P490X110-9N - DUAL]
U1_5  LTC 4449  [SMD_SOP65P490X110-9N - DUAL]
U1_6  LTC 4449  [SMD_SOP65P490X110-9N - DUAL]
U2  COINCRAFTA1  [SMD_QFNCOINCRAFTX90- 21N - 0.5BSC]
U3  COINCRAFTA1  [SMD_QFNCOINCRAFTX90- 21N - 0.5BSC]
U4  COINCRAFTA1  [SMD_QFNCOINCRAFTX90- 21N - 0.5BSC]
U5  COINCRAFTA1  [SMD_QFNCOINCRAFTX90- 21N - 0.5BSC]
U6  COINCRAFTA1  [SMD_QFNCOINCRAFTX90- 21N - 0.5BSC]
U7  COINCRAFTA1  [SMD_QFNCOINCRAFTX90- 21N - 0.5BSC]
U8  COINCRAFTA1  [SMD_QFNCOINCRAFTX90- 21N - 0.5BSC]
U9  COINCRAFTA1  [SMD_QFNCOINCRAFTX90- 21N - 0.5BSC]
U18  (OPT)BU33TD3WG-TR  [SMD_SOT26_SOT95P285X140-5N - DLV]
U19  BD33KA5WF  [SMD_SOIC127P602X173-8N]
U20  L78M05CDT-TR  [SMD_TO229P991X239-4AN_DPAK]
U22  (OPT) LM7805  [SMD_SOIC127P602X173-8N]
U23  (OPT) L7805CD2T-TR  [SMD_TO254P1524X483-3_4N_D2PAK]
U24  BD18KA5WF  [SMD_SOIC127P602X173-8N]
Y1  Q4.000 MHz HC-49SM SMD  [SMD_HC49_XTAL1140X480X420N]